# EAGLE board Resistor_Resistor (EAGLE 8.3.0), part 11 of 32
## Placement (x,y rotation side) (continued)
R13010  10K  [0201]  104.6,6.76 0 top
R13011  10K  [0201]  104.6,7.37 0 top
R13012  10K  [0201]  104.6,7.98 0 top
R13013  10K  [0201]  104.6,8.59 0 top
R13014  10K  [0201]  104.6,9.19 0 top
R13015  10K  [0201]  104.6,9.8 0 top
R13016  10K  [0201]  104.6,10.41 0 top
R13017  10K  [0201]  104.6,11.02 0 top
R13018  10K  [0201]  104.6,11.63 0 top
R13019  10K  [0201]  104.6,12.24 0 top
R13020  10K  [0201]  104.6,12.85 0 top
R13021  10K  [0201]  104.6,13.46 0 top
R13022  10K  [0201]  104.6,14.07 0 top
R13023  10K  [0201]  104.6,14.68 0 top
R13024  10K  [0201]  104.6,15.29 0 top
R13025  10K  [0201]  104.6,15.9 0 top
R13026  10K  [0201]  104.6,16.51 0 top
R13027  10K  [0201]  104.6,17.12 0 top
R13028  10K  [0201]  104.6,17.73 0 top
R13029  10K  [0201]  104.6,18.34 0 top
R13030  10K  [0201]  104.6,18.95 0 top
R13031  10K  [0201]  104.6,19.56 0 top
R13032  10K  [0201]  104.6,20.17 0 top
R13033  10K  [0201]  104.6,20.78 0 top
R13034  10K  [0201]  104.6,21.39 0 top
R13035  10K  [0201]  104.6,22 0 top
R13036  10K  [0201]  104.6,22.61 0 top
R13037  10K  [0201]  104.6,23.22 0 top
R13038  10K  [0201]  104.6,23.83 0 top
R13039  10K  [0201]  104.6,24.43 0 top
R13040  10K  [0201]  104.6,25.04 0 top
R13041  10K  [0201]  104.6,25.65 0 top
R13042  10K  [0201]  104.6,26.26 0 top
R13043  10K  [0201]  104.6,26.87 0 top
R13044  10K  [0201]  104.6,27.48 0 top
R13045  10K  [0201]  104.6,28.09 0 top
R13046  10K  [0201]  104.6,28.7 0 top
R13047  10K  [0201]  104.6,29.31 0 top
R13048  10K  [0201]  104.6,29.92 0 top
R13049  10K  [0201]  104.6,30.53 0 top
R13050  10K  [0201]  104.6,31.14 0 top
R13051  10K  [0201]  104.6,31.75 0 top
R13052  10K  [0201]  104.6,32.36 0 top
R13053  10K  [0201]  104.6,32.97 0 top
R13054  10K  [0201]  104.6,33.58 0 top
R13055  10K  [0201]  104.6,34.19 0 top
R13056  10K  [0201]  104.6,34.8 0 top
R13057  10K  [0201]  104.6,35.41 0 top
R13058  10K  [0201]  104.6,36.02 0 top
R13059  10K  [0201]  104.6,36.63 0 top
R13060  10K  [0201]  104.6,37.24 0 top
R13061  10K  [0201]  104.6,37.85 0 top
R13062  10K  [0201]  104.6,38.46 0 top
R13063  10K  [0201]  104.6,39.07 0 top
R13064  10K  [0201]  104.6,39.67 0 top
R13065  10K  [0201]  104.6,40.28 0 top
R13066  10K  [0201]  104.6,40.89 0 top
R13067  10K  [0201]  104.6,41.5 0 top
R13068  10K  [0201]  104.6,42.11 0 top
R13069  10K  [0201]  104.6,42.72 0 top
R13070  10K  [0201]  104.6,43.33 0 top
R13071  10K  [0201]  104.6,43.94 0 top
R13072  10K  [0201]  104.6,44.55 0 top
R13073  10K  [0201]  104.6,45.16 0 top
R13074  10K  [0201]  104.6,45.77 0 top
R13075  10K  [0201]  104.6,46.38 0 top
R13076  10K  [0201]  104.6,46.99 0 top
R13077  10K  [0201]  104.6,47.6 0 top
R13078  10K  [0201]  104.6,48.21 0 top
R13079  10K  [0201]  104.6,48.82 0 top
R13080  10K  [0201]  104.6,49.43 0 top
R13081  10K  [0201]  104.6,50.04 0 top
R13082  10K  [0201]  104.6,50.65 0 top
R13083  10K  [0201]  104.6,51.26 0 top
R13084  10K  [0201]  104.6,51.87 0 top
R13085  10K  [0201]  104.6,52.48 0 top
R13086  10K  [0201]  104.6,53.09 0 top
R13087  10K  [0201]  104.6,53.7 0 top
R13088  10K  [0201]  104.6,54.31 0 top
R13089  10K  [0201]  104.6,54.91 0 top
R13090  10K  [0201]  104.6,55.52 0 top
R13091  10K  [0201]  104.6,56.13 0 top
R13092  10K  [0201]  104.6,56.74 0 top
R13093  10K  [0201]  104.6,57.35 0 top
R13094  10K  [0201]  104.6,57.96 0 top
R13095  10K  [0201]  104.6,58.57 0 top
R13096  10K  [0201]  104.6,59.18 0 top
R13097  10K  [0201]  104.6,59.79 0 top
R13098  10K  [0201]  104.6,60.4 0 top
R13099  10K  [0201]  104.6,61.01 0 top
R13100  10K  [0201]  104.6,61.62 0 top
R13101  10K  [0201]  104.6,62.23 0 top
R13102  10K  [0201]  104.6,62.84 0 top
R13103  10K  [0201]  104.6,63.45 0 top
R13104  10K  [0201]  104.6,64.06 0 top
R13105  10K  [0201]  104.6,64.67 0 top
R13106  10K  [0201]  104.6,65.28 0 top
R13107  10K  [0201]  104.6,65.89 0 top
R13108  10K  [0201]  104.6,66.5 0 top
R13109  10K  [0201]  104.6,67.11 0 top
R13110  10K  [0201]  104.6,67.72 0 top
R13111  10K  [0201]  104.6,68.33 0 top
R13112  10K  [0201]  104.6,68.94 0 top
R13113  10K  [0201]  104.6,69.55 0 top
R13114  10K  [0201]  104.6,70.15 0 top
R13115  10K  [0201]  104.6,70.76 0 top
R13116  10K  [0201]  104.6,71.37 0 top
R13117  10K  [0201]  104.6,71.98 0 top
R13118  10K  [0201]  104.6,72.59 0 top
R13119  10K  [0201]  104.6,73.2 0 top
R13120  10K  [0201]  104.6,73.81 0 top
R13121  10K  [0201]  104.6,74.42 0 top
R13122  10K  [0201]  104.6,75.03 0 top
R13123  10K  [0201]  104.6,75.64 0 top
R13124  10K  [0201]  104.6,76.25 0 top
R13125  10K  [0201]  104.6,76.86 0 top
R13126  10K  [0201]  104.6,77.47 0 top
R13127  10K  [0201]  104.6,78.08 0 top
R13128  10K  [0201]  104.6,78.69 0 top
R13129  10K  [0201]  104.6,79.3 0 top
R13130  10K  [0201]  104.6,79.91 0 top
R13131  10K  [0201]  104.6,80.52 0 top
R13132  10K  [0201]  104.6,81.13 0 top
R13133  10K  [0201]  104.6,81.74 0 top
R13134  10K  [0201]  104.6,82.35 0 top
R13135  10K  [0201]  104.6,82.96 0 top
R13136  10K  [0201]  104.6,83.57 0 top
R13137  10K  [0201]  104.6,84.18 0 top
R13138  10K  [0201]  104.6,84.79 0 top
R13139  10K  [0201]  104.6,85.39 0 top
R13140  10K  [0201]  104.6,86 0 top
R13141  10K  [0201]  104.6,86.61 0 top
R13142  10K  [0201]  104.6,87.22 0 top
R13143  10K  [0201]  104.6,87.83 0 top
R13144  10K  [0201]  104.6,88.44 0 top
R13145  10K  [0201]  104.6,89.05 0 top
R13146  10K  [0201]  104.6,89.66 0 top
R13147  10K  [0201]  104.6,90.27 0 top
R13148  10K  [0201]  104.6,90.88 0 top
R13149  10K  [0201]  104.6,91.49 0 top
R13150  10K  [0201]  104.6,92.1 0 top
R13151  10K  [0201]  104.6,92.71 0 top
R13152  10K  [0201]  104.6,93.32 0 top
R13153  10K  [0201]  104.6,93.93 0 top
R13154  10K  [0201]  104.6,94.54 0 top
R13155  10K  [0201]  104.6,95.15 0 top
R13156  10K  [0201]  104.6,95.76 0 top
R13157  10K  [0201]  104.6,96.37 0 top
R13158  10K  [0201]  104.6,96.98 0 top
R13159  10K  [0201]  104.6,97.59 0 top
R13160  10K  [0201]  104.6,98.2 0 top
R13161  10K  [0201]  104.6,98.81 0 top
R13162  10K  [0201]  104.6,99.42 0 top
R13163  10K  [0201]  104.6,100.03 0 top
R13164  10K  [0201]  104.6,100.63 0 top
R13165  10K  [0201]  104.6,101.24 0 top
R13166  10K  [0201]  104.6,101.85 0 top
R13167  10K  [0201]  104.6,102.46 0 top
R13168  10K  [0201]  104.6,103.07 0 top
R13169  10K  [0201]  104.6,103.68 0 top
R13170  10K  [0201]  104.6,104.29 0 top
R13171  10K  [0201]  104.6,104.9 0 top
R13172  10K  [0201]  104.6,105.51 0 top
R13173  10K  [0201]  104.6,106.12 0 top
R13174  10K  [0201]  104.6,106.73 0 top
R13175  10K  [0201]  104.6,107.34 0 top
R13176  10K  [0201]  104.6,107.95 0 top
R13177  10K  [0201]  104.6,108.56 0 top
R13178  10K  [0201]  104.6,109.17 0 top
R13179  10K  [0201]  104.6,109.78 0 top
R13180  10K  [0201]  104.6,110.39 0 top
R13181  10K  [0201]  104.6,111 0 top
R13182  10K  [0201]  104.6,111.61 0 top
R13183  10K  [0201]  104.6,112.22 0 top
R13184  10K  [0201]  104.6,112.83 0 top
R13185  10K  [0201]  104.6,113.44 0 top
R13186  10K  [0201]  104.6,114.05 0 top
R13187  10K  [0201]  104.6,114.66 0 top
R13188  10K  [0201]  104.6,115.27 0 top
R13189  10K  [0201]  104.6,115.87 0 top
R13190  10K  [0201]  104.6,116.48 0 top
R13191  10K  [0201]  104.6,117.09 0 top
R13192  10K  [0201]  104.6,117.7 0 top
R13193  10K  [0201]  104.6,118.31 0 top
R13194  10K  [0201]  104.6,118.92 0 top
R13195  10K  [0201]  104.6,119.53 0 top
R13196  10K  [0201]  104.6,120.14 0 top
R13197  10K  [0201]  104.6,120.75 0 top
R13198  10K  [0201]  104.6,121.36 0 top
R13199  10K  [0201]  104.6,121.97 0 top
R13200  10K  [0201]  104.6,122.58 0 top
R13201  10K  [0201]  105.82,1.27 0 top
R13202  10K  [0201]  105.82,1.88 0 top
R13203  10K  [0201]  105.82,2.49 0 top
R13204  10K  [0201]  105.82,3.1 0 top
R13205  10K  [0201]  105.82,3.71 0 top
R13206  10K  [0201]  105.82,4.32 0 top
R13207  10K  [0201]  105.82,4.93 0 top
R13208  10K  [0201]  105.82,5.54 0 top
R13209  10K  [0201]  105.82,6.15 0 top
R13210  10K  [0201]  105.82,6.76 0 top
R13211  10K  [0201]  105.82,7.37 0 top
R13212  10K  [0201]  105.82,7.98 0 top
R13213  10K  [0201]  105.82,8.59 0 top
R13214  10K  [0201]  105.82,9.19 0 top
R13215  10K  [0201]  105.82,9.8 0 top
R13216  10K  [0201]  105.82,10.41 0 top
R13217  10K  [0201]  105.82,11.02 0 top
R13218  10K  [0201]  105.82,11.63 0 top
R13219  10K  [0201]  105.82,12.24 0 top
R13220  10K  [0201]  105.82,12.85 0 top
R13221  10K  [0201]  105.82,13.46 0 top
R13222  10K  [0201]  105.82,14.07 0 top
R13223  10K  [0201]  105.82,14.68 0 top
R13224  10K  [0201]  105.82,15.29 0 top
R13225  10K  [0201]  105.82,15.9 0 top
R13226  10K  [0201]  105.82,16.51 0 top
R13227  10K  [0201]  105.82,17.12 0 top
R13228  10K  [0201]  105.82,17.73 0 top
R13229  10K  [0201]  105.82,18.34 0 top
R13230  10K  [0201]  105.82,18.95 0 top
R13231  10K  [0201]  105.82,19.56 0 top
R13232  10K  [0201]  105.82,20.17 0 top
R13233  10K  [0201]  105.82,20.78 0 top
R13234  10K  [0201]  105.82,21.39 0 top
R13235  10K  [0201]  105.82,22 0 top
R13236  10K  [0201]  105.82,22.61 0 top
R13237  10K  [0201]  105.82,23.22 0 top
R13238  10K  [0201]  105.82,23.83 0 top
R13239  10K  [0201]  105.82,24.43 0 top
R13240  10K  [0201]  105.82,25.04 0 top
R13241  10K  [0201]  105.82,25.65 0 top
R13242  10K  [0201]  105.82,26.26 0 top
R13243  10K  [0201]  105.82,26.87 0 top
R13244  10K  [0201]  105.82,27.48 0 top
R13245  10K  [0201]  105.82,28.09 0 top
R13246  10K  [0201]  105.82,28.7 0 top
R13247  10K  [0201]  105.82,29.31 0 top
R13248  10K  [0201]  105.82,29.92 0 top
R13249  10K  [0201]  105.82,30.53 0 top
R13250  10K  [0201]  105.82,31.14 0 top
R13251  10K  [0201]  105.82,31.75 0 top
R13252  10K  [0201]  105.82,32.36 0 top
R13253  10K  [0201]  105.82,32.97 0 top
R13254  10K  [0201]  105.82,33.58 0 top
R13255  10K  [0201]  105.82,34.19 0 top
R13256  10K  [0201]  105.82,34.8 0 top
R13257  10K  [0201]  105.82,35.41 0 top
R13258  10K  [0201]  105.82,36.02 0 top
R13259  10K  [0201]  105.82,36.63 0 top
R13260  10K  [0201]  105.82,37.24 0 top
R13261  10K  [0201]  105.82,37.85 0 top
R13262  10K  [0201]  105.82,38.46 0 top
R13263  10K  [0201]  105.82,39.07 0 top
R13264  10K  [0201]  105.82,39.67 0 top
R13265  10K  [0201]  105.82,40.28 0 top
R13266  10K  [0201]  105.82,40.89 0 top
R13267  10K  [0201]  105.82,41.5 0 top
R13268  10K  [0201]  105.82,42.11 0 top
R13269  10K  [0201]  105.82,42.72 0 top
R13270  10K  [0201]  105.82,43.33 0 top
R13271  10K  [0201]  105.82,43.94 0 top
R13272  10K  [0201]  105.82,44.55 0 top
R13273  10K  [0201]  105.82,45.16 0 top
R13274  10K  [0201]  105.82,45.77 0 top
R13275  10K  [0201]  105.82,46.38 0 top
R13276  10K  [0201]  105.82,46.99 0 top
R13277  10K  [0201]  105.82,47.6 0 top
R13278  10K  [0201]  105.82,48.21 0 top
R13279  10K  [0201]  105.82,48.82 0 top
R13280  10K  [0201]  105.82,49.43 0 top
R13281  10K  [0201]  105.82,50.04 0 top
R13282  10K  [0201]  105.82,50.65 0 top
R13283  10K  [0201]  105.82,51.26 0 top
R13284  10K  [0201]  105.82,51.87 0 top
R13285  10K  [0201]  105.82,52.48 0 top
R13286  10K  [0201]  105.82,53.09 0 top
R13287  10K  [0201]  105.82,53.7 0 top
R13288  10K  [0201]  105.82,54.31 0 top
R13289  10K  [0201]  105.82,54.91 0 top
R13290  10K  [0201]  105.82,55.52 0 top
R13291  10K  [0201]  105.82,56.13 0 top
R13292  10K  [0201]  105.82,56.74 0 top
R13293  10K  [0201]  105.82,57.35 0 top
R13294  10K  [0201]  105.82,57.96 0 top
R13295  10K  [0201]  105.82,58.57 0 top
R13296  10K  [0201]  105.82,59.18 0 top
R13297  10K  [0201]  105.82,59.79 0 top
R13298  10K  [0201]  105.82,60.4 0 top
R13299  10K  [0201]  105.82,61.01 0 top
R13300  10K  [0201]  105.82,61.62 0 top
R13301  10K  [0201]  105.82,62.23 0 top
R13302  10K  [0201]  105.82,62.84 0 top
R13303  10K  [0201]  105.82,63.45 0 top
R13304  10K  [0201]  105.82,64.06 0 top
R13305  10K  [0201]  105.82,64.67 0 top
R13306  10K  [0201]  105.82,65.28 0 top
R13307  10K  [0201]  105.82,65.89 0 top
R13308  10K  [0201]  105.82,66.5 0 top
R13309  10K  [0201]  105.82,67.11 0 top
R13310  10K  [0201]  105.82,67.72 0 top
R13311  10K  [0201]  105.82,68.33 0 top
R13312  10K  [0201]  105.82,68.94 0 top
R13313  10K  [0201]  105.82,69.55 0 top
R13314  10K  [0201]  105.82,70.15 0 top
R13315  10K  [0201]  105.82,70.76 0 top
R13316  10K  [0201]  105.82,71.37 0 top
R13317  10K  [0201]  105.82,71.98 0 top
R13318  10K  [0201]  105.82,72.59 0 top
R13319  10K  [0201]  105.82,73.2 0 top
R13320  10K  [0201]  105.82,73.81 0 top
R13321  10K  [0201]  105.82,74.42 0 top
R13322  10K  [0201]  105.82,75.03 0 top
R13323  10K  [0201]  105.82,75.64 0 top
R13324  10K  [0201]  105.82,76.25 0 top
R13325  10K  [0201]  105.82,76.86 0 top
R13326  10K  [0201]  105.82,77.47 0 top
R13327  10K  [0201]  105.82,78.08 0 top
R13328  10K  [0201]  105.82,78.69 0 top
R13329  10K  [0201]  105.82,79.3 0 top
R13330  10K  [0201]  105.82,79.91 0 top
R13331  10K  [0201]  105.82,80.52 0 top
R13332  10K  [0201]  105.82,81.13 0 top
R13333  10K  [0201]  105.82,81.74 0 top
R13334  10K  [0201]  105.82,82.35 0 top
R13335  10K  [0201]  105.82,82.96 0 top
R13336  10K  [0201]  105.82,83.57 0 top
R13337  10K  [0201]  105.82,84.18 0 top
R13338  10K  [0201]  105.82,84.79 0 top
R13339  10K  [0201]  105.82,85.39 0 top
R13340  10K  [0201]  105.82,86 0 top
R13341  10K  [0201]  105.82,86.61 0 top
R13342  10K  [0201]  105.82,87.22 0 top
R13343  10K  [0201]  105.82,87.83 0 top
R13344  10K  [0201]  105.82,88.44 0 top
R13345  10K  [0201]  105.82,89.05 0 top
R13346  10K  [0201]  105.82,89.66 0 top
R13347  10K  [0201]  105.82,90.27 0 top
R13348  10K  [0201]  105.82,90.88 0 top
R13349  10K  [0201]  105.82,91.49 0 top
R13350  10K  [0201]  105.82,92.1 0 top
R13351  10K  [0201]  105.82,92.71 0 top
R13352  10K  [0201]  105.82,93.32 0 top
R13353  10K  [0201]  105.82,93.93 0 top
R13354  10K  [0201]  105.82,94.54 0 top
R13355  10K  [0201]  105.82,95.15 0 top
R13356  10K  [0201]  105.82,95.76 0 top
R13357  10K  [0201]  105.82,96.37 0 top
R13358  10K  [0201]  105.82,96.98 0 top
R13359  10K  [0201]  105.82,97.59 0 top
R13360  10K  [0201]  105.82,98.2 0 top
R13361  10K  [0201]  105.82,98.81 0 top
R13362  10K  [0201]  105.82,99.42 0 top
R13363  10K  [0201]  105.82,100.03 0 top
R13364  10K  [0201]  105.82,100.63 0 top
R13365  10K  [0201]  105.82,101.24 0 top
R13366  10K  [0201]  105.82,101.85 0 top
R13367  10K  [0201]  105.82,102.46 0 top
R13368  10K  [0201]  105.82,103.07 0 top
R13369  10K  [0201]  105.82,103.68 0 top
R13370  10K  [0201]  105.82,104.29 0 top
R13371  10K  [0201]  105.82,104.9 0 top
R13372  10K  [0201]  105.82,105.51 0 top
R13373  10K  [0201]  105.82,106.12 0 top
R13374  10K  [0201]  105.82,106.73 0 top
R13375  10K  [0201]  105.82,107.34 0 top
R13376  10K  [0201]  105.82,107.95 0 top
R13377  10K  [0201]  105.82,108.56 0 top
R13378  10K  [0201]  105.82,109.17 0 top
R13379  10K  [0201]  105.82,109.78 0 top
R13380  10K  [0201]  105.82,110.39 0 top
R13381  10K  [0201]  105.82,111 0 top
R13382  10K  [0201]  105.82,111.61 0 top
R13383  10K  [0201]  105.82,112.22 0 top
R13384  10K  [0201]  105.82,112.83 0 top
R13385  10K  [0201]  105.82,113.44 0 top
R13386  10K  [0201]  105.82,114.05 0 top
R13387  10K  [0201]  105.82,114.66 0 top
R13388  10K  [0201]  105.82,115.27 0 top
R13389  10K  [0201]  105.82,115.87 0 top
R13390  10K  [0201]  105.82,116.48 0 top
R13391  10K  [0201]  105.82,117.09 0 top
R13392  10K  [0201]  105.82,117.7 0 top
R13393  10K  [0201]  105.82,118.31 0 top
R13394  10K  [0201]  105.82,118.92 0 top
R13395  10K  [0201]  105.82,119.53 0 top
R13396  10K  [0201]  105.82,120.14 0 top
R13397  10K  [0201]  105.82,120.75 0 top
R13398  10K  [0201]  105.82,121.36 0 top
R13399  10K  [0201]  105.82,121.97 0 top
R13400  10K  [0201]  105.82,122.58 0 top
R13401  10K  [0201]  107.04,1.27 0 top
R13402  10K  [0201]  107.04,1.88 0 top
R13403  10K  [0201]  107.04,2.49 0 top
R13404  10K  [0201]  107.04,3.1 0 top
R13405  10K  [0201]  107.04,3.71 0 top
R13406  10K  [0201]  107.04,4.32 0 top
R13407  10K  [0201]  107.04,4.93 0 top
R13408  10K  [0201]  107.04,5.54 0 top
R13409  10K  [0201]  107.04,6.15 0 top
R13410  10K  [0201]  107.04,6.76 0 top
R13411  10K  [0201]  107.04,7.37 0 top
R13412  10K  [0201]  107.04,7.98 0 top
R13413  10K  [0201]  107.04,8.59 0 top
R13414  10K  [0201]  107.04,9.19 0 top
R13415  10K  [0201]  107.04,9.8 0 top
R13416  10K  [0201]  107.04,10.41 0 top
R13417  10K  [0201]  107.04,11.02 0 top
R13418  10K  [0201]  107.04,11.63 0 top
R13419  10K  [0201]  107.04,12.24 0 top
R13420  10K  [0201]  107.04,12.85 0 top
R13421  10K  [0201]  107.04,13.46 0 top
R13422  10K  [0201]  107.04,14.07 0 top
R13423  10K  [0201]  107.04,14.68 0 top
R13424  10K  [0201]  107.04,15.29 0 top
R13425  10K  [0201]  107.04,15.9 0 top
R13426  10K  [0201]  107.04,16.51 0 top
R13427  10K  [0201]  107.04,17.12 0 top
R13428  10K  [0201]  107.04,17.73 0 top
R13429  10K  [0201]  107.04,18.34 0 top
R13430  10K  [0201]  107.04,18.95 0 top
R13431  10K  [0201]  107.04,19.56 0 top
R13432  10K  [0201]  107.04,20.17 0 top
R13433  10K  [0201]  107.04,20.78 0 top
R13434  10K  [0201]  107.04,21.39 0 top
R13435  10K  [0201]  107.04,22 0 top
R13436  10K  [0201]  107.04,22.61 0 top
R13437  10K  [0201]  107.04,23.22 0 top
R13438  10K  [0201]  107.04,23.83 0 top
R13439  10K  [0201]  107.04,24.43 0 top
R13440  10K  [0201]  107.04,25.04 0 top
R13441  10K  [0201]  107.04,25.65 0 top
R13442  10K  [0201]  107.04,26.26 0 top
R13443  10K  [0201]  107.04,26.87 0 top
R13444  10K  [0201]  107.04,27.48 0 top
R13445  10K  [0201]  107.04,28.09 0 top
R13446  10K  [0201]  107.04,28.7 0 top
R13447  10K  [0201]  107.04,29.31 0 top
R13448  10K  [0201]  107.04,29.92 0 top
R13449  10K  [0201]  107.04,30.53 0 top
R13450  10K  [0201]  107.04,31.14 0 top
R13451  10K  [0201]  107.04,31.75 0 top
R13452  10K  [0201]  107.04,32.36 0 top
R13453  10K  [0201]  107.04,32.97 0 top
R13454  10K  [0201]  107.04,33.58 0 top
R13455  10K  [0201]  107.04,34.19 0 top
R13456  10K  [0201]  107.04,34.8 0 top
R13457  10K  [0201]  107.04,35.41 0 top
R13458  10K  [0201]  107.04,36.02 0 top
R13459  10K  [0201]  107.04,36.63 0 top
R13460  10K  [0201]  107.04,37.24 0 top
R13461  10K  [0201]  107.04,37.85 0 top
R13462  10K  [0201]  107.04,38.46 0 top
R13463  10K  [0201]  107.04,39.07 0 top
R13464  10K  [0201]  107.04,39.67 0 top
R13465  10K  [0201]  107.04,40.28 0 top
R13466  10K  [0201]  107.04,40.89 0 top
R13467  10K  [0201]  107.04,41.5 0 top
R13468  10K  [0201]  107.04,42.11 0 top
R13469  10K  [0201]  107.04,42.72 0 top
R13470  10K  [0201]  107.04,43.33 0 top
R13471  10K  [0201]  107.04,43.94 0 top
R13472  10K  [0201]  107.04,44.55 0 top
R13473  10K  [0201]  107.04,45.16 0 top
R13474  10K  [0201]  107.04,45.77 0 top
R13475  10K  [0201]  107.04,46.38 0 top
R13476  10K  [0201]  107.04,46.99 0 top
R13477  10K  [0201]  107.04,47.6 0 top
R13478  10K  [0201]  107.04,48.21 0 top
R13479  10K  [0201]  107.04,48.82 0 top
R13480  10K  [0201]  107.04,49.43 0 top
R13481  10K  [0201]  107.04,50.04 0 top
R13482  10K  [0201]  107.04,50.65 0 top
R13483  10K  [0201]  107.04,51.26 0 top
R13484  10K  [0201]  107.04,51.87 0 top
R13485  10K  [0201]  107.04,52.48 0 top
R13486  10K  [0201]  107.04,53.09 0 top
R13487  10K  [0201]  107.04,53.7 0 top
R13488  10K  [0201]  107.04,54.31 0 top
R13489  10K  [0201]  107.04,54.91 0 top
R13490  10K  [0201]  107.04,55.52 0 top
R13491  10K  [0201]  107.04,56.13 0 top
R13492  10K  [0201]  107.04,56.74 0 top
R13493  10K  [0201]  107.04,57.35 0 top
R13494  10K  [0201]  107.04,57.96 0 top
R13495  10K  [0201]  107.04,58.57 0 top
R13496  10K  [0201]  107.04,59.18 0 top
R13497  10K  [0201]  107.04,59.79 0 top
R13498  10K  [0201]  107.04,60.4 0 top
R13499  10K  [0201]  107.04,61.01 0 top
R13500  10K  [0201]  107.04,61.62 0 top
R13501  10K  [0201]  107.04,62.23 0 top
R13502  10K  [0201]  107.04,62.84 0 top
R13503  10K  [0201]  107.04,63.45 0 top
R13504  10K  [0201]  107.04,64.06 0 top
R13505  10K  [0201]  107.04,64.67 0 top
R13506  10K  [0201]  107.04,65.28 0 top
R13507  10K  [0201]  107.04,65.89 0 top
R13508  10K  [0201]  107.04,66.5 0 top
R13509  10K  [0201]  107.04,67.11 0 top
R13510  10K  [0201]  107.04,67.72 0 top
R13511  10K  [0201]  107.04,68.33 0 top
R13512  10K  [0201]  107.04,68.94 0 top
R13513  10K  [0201]  107.04,69.55 0 top
R13514  10K  [0201]  107.04,70.15 0 top
R13515  10K  [0201]  107.04,70.76 0 top
R13516  10K  [0201]  107.04,71.37 0 top
R13517  10K  [0201]  107.04,71.98 0 top
R13518  10K  [0201]  107.04,72.59 0 top
R13519  10K  [0201]  107.04,73.2 0 top
R13520  10K  [0201]  107.04,73.81 0 top
R13521  10K  [0201]  107.04,74.42 0 top
R13522  10K  [0201]  107.04,75.03 0 top
R13523  10K  [0201]  107.04,75.64 0 top
R13524  10K  [0201]  107.04,76.25 0 top
R13525  10K  [0201]  107.04,76.86 0 top
R13526  10K  [0201]  107.04,77.47 0 top
R13527  10K  [0201]  107.04,78.08 0 top
R13528  10K  [0201]  107.04,78.69 0 top
R13529  10K  [0201]  107.04,79.3 0 top
R13530  10K  [0201]  107.04,79.91 0 top
R13531  10K  [0201]  107.04,80.52 0 top
R13532  10K  [0201]  107.04,81.13 0 top
R13533  10K  [0201]  107.04,81.74 0 top
R13534  10K  [0201]  107.04,82.35 0 top
R13535  10K  [0201]  107.04,82.96 0 top
R13536  10K  [0201]  107.04,83.57 0 top
R13537  10K  [0201]  107.04,84.18 0 top
R13538  10K  [0201]  107.04,84.79 0 top
R13539  10K  [0201]  107.04,85.39 0 top
R13540  10K  [0201]  107.04,86 0 top
R13541  10K  [0201]  107.04,86.61 0 top
R13542  10K  [0201]  107.04,87.22 0 top
R13543  10K  [0201]  107.04,87.83 0 top
R13544  10K  [0201]  107.04,88.44 0 top
R13545  10K  [0201]  107.04,89.05 0 top
R13546  10K  [0201]  107.04,89.66 0 top
R13547  10K  [0201]  107.04,90.27 0 top
R13548  10K  [0201]  107.04,90.88 0 top
R13549  10K  [0201]  107.04,91.49 0 top
R13550  10K  [0201]  107.04,92.1 0 top
R13551  10K  [0201]  107.04,92.71 0 top
R13552  10K  [0201]  107.04,93.32 0 top
R13553  10K  [0201]  107.04,93.93 0 top
R13554  10K  [0201]  107.04,94.54 0 top
R13555  10K  [0201]  107.04,95.15 0 top
R13556  10K  [0201]  107.04,95.76 0 top
R13557  10K  [0201]  107.04,96.37 0 top
R13558  10K  [0201]  107.04,96.98 0 top
R13559  10K  [0201]  107.04,97.59 0 top
R13560  10K  [0201]  107.04,98.2 0 top
R13561  10K  [0201]  107.04,98.81 0 top
R13562  10K  [0201]  107.04,99.42 0 top
R13563  10K  [0201]  107.04,100.03 0 top
R13564  10K  [0201]  107.04,100.63 0 top
R13565  10K  [0201]  107.04,101.24 0 top
R13566  10K  [0201]  107.04,101.85 0 top
R13567  10K  [0201]  107.04,102.46 0 top
R13568  10K  [0201]  107.04,103.07 0 top
R13569  10K  [0201]  107.04,103.68 0 top
R13570  10K  [0201]  107.04,104.29 0 top
R13571  10K  [0201]  107.04,104.9 0 top
R13572  10K  [0201]  107.04,105.51 0 top
R13573  10K  [0201]  107.04,106.12 0 top
R13574  10K  [0201]  107.04,106.73 0 top
R13575  10K  [0201]  107.04,107.34 0 top
R13576  10K  [0201]  107.04,107.95 0 top
R13577  10K  [0201]  107.04,108.56 0 top
R13578  10K  [0201]  107.04,109.17 0 top
R13579  10K  [0201]  107.04,109.78 0 top
R13580  10K  [0201]  107.04,110.39 0 top
R13581  10K  [0201]  107.04,111 0 top
R13582  10K  [0201]  107.04,111.61 0 top
R13583  10K  [0201]  107.04,112.22 0 top
R13584  10K  [0201]  107.04,112.83 0 top
R13585  10K  [0201]  107.04,113.44 0 top
R13586  10K  [0201]  107.04,114.05 0 top
R13587  10K  [0201]  107.04,114.66 0 top
R13588  10K  [0201]  107.04,115.27 0 top
R13589  10K  [0201]  107.04,115.87 0 top
R13590  10K  [0201]  107.04,116.48 0 top
R13591  10K  [0201]  107.04,117.09 0 top
R13592  10K  [0201]  107.04,117.7 0 top
R13593  10K  [0201]  107.04,118.31 0 top
R13594  10K  [0201]  107.04,118.92 0 top
R13595  10K  [0201]  107.04,119.53 0 top
R13596  10K  [0201]  107.04,120.14 0 top
R13597  10K  [0201]  107.04,120.75 0 top
R13598  10K  [0201]  107.04,121.36 0 top
R13599  10K  [0201]  107.04,121.97 0 top
R13600  10K  [0201]  107.04,122.58 0 top
R13601  10K  [0201]  108.25,1.27 0 top
R13602  10K  [0201]  108.25,1.88 0 top
R13603  10K  [0201]  108.25,2.49 0 top
R13604  10K  [0201]  108.25,3.1 0 top
R13605  10K  [0201]  108.25,3.71 0 top
R13606  10K  [0201]  108.25,4.32 0 top
R13607  10K  [0201]  108.25,4.93 0 top
R13608  10K  [0201]  108.25,5.54 0 top
R13609  10K  [0201]  108.25,6.15 0 top
R13610  10K  [0201]  108.25,6.76 0 top
R13611  10K  [0201]  108.25,7.37 0 top
R13612  10K  [0201]  108.25,7.98 0 top
R13613  10K  [0201]  108.25,8.59 0 top
R13614  10K  [0201]  108.25,9.19 0 top
R13615  10K  [0201]  108.25,9.8 0 top
R13616  10K  [0201]  108.25,10.41 0 top
R13617  10K  [0201]  108.25,11.02 0 top
R13618  10K  [0201]  108.25,11.63 0 top
R13619  10K  [0201]  108.25,12.24 0 top
R13620  10K  [0201]  108.25,12.85 0 top
R13621  10K  [0201]  108.25,13.46 0 top
R13622  10K  [0201]  108.25,14.07 0 top
R13623  10K  [0201]  108.25,14.68 0 top
R13624  10K  [0201]  108.25,15.29 0 top
R13625  10K  [0201]  108.25,15.9 0 top
R13626  10K  [0201]  108.25,16.51 0 top
R13627  10K  [0201]  108.25,17.12 0 top
R13628  10K  [0201]  108.25,17.73 0 top
R13629  10K  [0201]  108.25,18.34 0 top
R13630  10K  [0201]  108.25,18.95 0 top
R13631  10K  [0201]  108.25,19.56 0 top
R13632  10K  [0201]  108.25,20.17 0 top
R13633  10K  [0201]  108.25,20.78 0 top
R13634  10K  [0201]  108.25,21.39 0 top
R13635  10K  [0201]  108.25,22 0 top
R13636  10K  [0201]  108.25,22.61 0 top
R13637  10K  [0201]  108.25,23.22 0 top
R13638  10K  [0201]  108.25,23.83 0 top
R13639  10K  [0201]  108.25,24.43 0 top
R13640  10K  [0201]  108.25,25.04 0 top
R13641  10K  [0201]  108.25,25.65 0 top
R13642  10K  [0201]  108.25,26.26 0 top
R13643  10K  [0201]  108.25,26.87 0 top
R13644  10K  [0201]  108.25,27.48 0 top
R13645  10K  [0201]  108.25,28.09 0 top
R13646  10K  [0201]  108.25,28.7 0 top
R13647  10K  [0201]  108.25,29.31 0 top
R13648  10K  [0201]  108.25,29.92 0 top
R13649  10K  [0201]  108.25,30.53 0 top
R13650  10K  [0201]  108.25,31.14 0 top
R13651  10K  [0201]  108.25,31.75 0 top
R13652  10K  [0201]  108.25,32.36 0 top
R13653  10K  [0201]  108.25,32.97 0 top
R13654  10K  [0201]  108.25,33.58 0 top
R13655  10K  [0201]  108.25,34.19 0 top
R13656  10K  [0201]  108.25,34.8 0 top
R13657  10K  [0201]  108.25,35.41 0 top
R13658  10K  [0201]  108.25,36.02 0 top
R13659  10K  [0201]  108.25,36.63 0 top
R13660  10K  [0201]  108.25,37.24 0 top
R13661  10K  [0201]  108.25,37.85 0 top
R13662  10K  [0201]  108.25,38.46 0 top
R13663  10K  [0201]  108.25,39.07 0 top
R13664  10K  [0201]  108.25,39.67 0 top
R13665  10K  [0201]  108.25,40.28 0 top
R13666  10K  [0201]  108.25,40.89 0 top
R13667  10K  [0201]  108.25,41.5 0 top
R13668  10K  [0201]  108.25,42.11 0 top
R13669  10K  [0201]  108.25,42.72 0 top
R13670  10K  [0201]  108.25,43.33 0 top
R13671  10K  [0201]  108.25,43.94 0 top
R13672  10K  [0201]  108.25,44.55 0 top
R13673  10K  [0201]  108.25,45.16 0 top
R13674  10K  [0201]  108.25,45.77 0 top
R13675  10K  [0201]  108.25,46.38 0 top
R13676  10K  [0201]  108.25,46.99 0 top
R13677  10K  [0201]  108.25,47.6 0 top
R13678  10K  [0201]  108.25,48.21 0 top
R13679  10K  [0201]  108.25,48.82 0 top
R13680  10K  [0201]  108.25,49.43 0 top
R13681  10K  [0201]  108.25,50.04 0 top
R13682  10K  [0201]  108.25,50.65 0 top
R13683  10K  [0201]  108.25,51.26 0 top
R13684  10K  [0201]  108.25,51.87 0 top
R13685  10K  [0201]  108.25,52.48 0 top
R13686  10K  [0201]  108.25,53.09 0 top
R13687  10K  [0201]  108.25,53.7 0 top
R13688  10K  [0201]  108.25,54.31 0 top
R13689  10K  [0201]  108.25,54.91 0 top
R13690  10K  [0201]  108.25,55.52 0 top
R13691  10K  [0201]  108.25,56.13 0 top
R13692  10K  [0201]  108.25,56.74 0 top
R13693  10K  [0201]  108.25,57.35 0 top
R13694  10K  [0201]  108.25,57.96 0 top
R13695  10K  [0201]  108.25,58.57 0 top
R13696  10K  [0201]  108.25,59.18 0 top
R13697  10K  [0201]  108.25,59.79 0 top
R13698  10K  [0201]  108.25,60.4 0 top
R13699  10K  [0201]  108.25,61.01 0 top
R13700  10K  [0201]  108.25,61.62 0 top
R13701  10K  [0201]  108.25,62.23 0 top
R13702  10K  [0201]  108.25,62.84 0 top
R13703  10K  [0201]  108.25,63.45 0 top
R13704  10K  [0201]  108.25,64.06 0 top
R13705  10K  [0201]  108.25,64.67 0 top
R13706  10K  [0201]  108.25,65.28 0 top
R13707  10K  [0201]  108.25,65.89 0 top
R13708  10K  [0201]  108.25,66.5 0 top
R13709  10K  [0201]  108.25,67.11 0 top
R13710  10K  [0201]  108.25,67.72 0 top
R13711  10K  [0201]  108.25,68.33 0 top
R13712  10K  [0201]  108.25,68.94 0 top
R13713  10K  [0201]  108.25,69.55 0 top
R13714  10K  [0201]  108.25,70.15 0 top
R13715  10K  [0201]  108.25,70.76 0 top
R13716  10K  [0201]  108.25,71.37 0 top
R13717  10K  [0201]  108.25,71.98 0 top
R13718  10K  [0201]  108.25,72.59 0 top
R13719  10K  [0201]  108.25,73.2 0 top
R13720  10K  [0201]  108.25,73.81 0 top
R13721  10K  [0201]  108.25,74.42 0 top
R13722  10K  [0201]  108.25,75.03 0 top
R13723  10K  [0201]  108.25,75.64 0 top
R13724  10K  [0201]  108.25,76.25 0 top
R13725  10K  [0201]  108.25,76.86 0 top
R13726  10K  [0201]  108.25,77.47 0 top
R13727  10K  [0201]  108.25,78.08 0 top
R13728  10K  [0201]  108.25,78.69 0 top
R13729  10K  [0201]  108.25,79.3 0 top
R13730  10K  [0201]  108.25,79.91 0 top
R13731  10K  [0201]  108.25,80.52 0 top
R13732  10K  [0201]  108.25,81.13 0 top
R13733  10K  [0201]  108.25,81.74 0 top
R13734  10K  [0201]  108.25,82.35 0 top
R13735  10K  [0201]  108.25,82.96 0 top
R13736  10K  [0201]  108.25,83.57 0 top
R13737  10K  [0201]  108.25,84.18 0 top
R13738  10K  [0201]  108.25,84.79 0 top
R13739  10K  [0201]  108.25,85.39 0 top
R13740  10K  [0201]  108.25,86 0 top
R13741  10K  [0201]  108.25,86.61 0 top
R13742  10K  [0201]  108.25,87.22 0 top
R13743  10K  [0201]  108.25,87.83 0 top
R13744  10K  [0201]  108.25,88.44 0 top
R13745  10K  [0201]  108.25,89.05 0 top
R13746  10K  [0201]  108.25,89.66 0 top
R13747  10K  [0201]  108.25,90.27 0 top
R13748  10K  [0201]  108.25,90.88 0 top
R13749  10K  [0201]  108.25,91.49 0 top
R13750  10K  [0201]  108.25,92.1 0 top
R13751  10K  [0201]  108.25,92.71 0 top
R13752  10K  [0201]  108.25,93.32 0 top
R13753  10K  [0201]  108.25,93.93 0 top
R13754  10K  [0201]  108.25,94.54 0 top
R13755  10K  [0201]  108.25,95.15 0 top
R13756  10K  [0201]  108.25,95.76 0 top
R13757  10K  [0201]  108.25,96.37 0 top
R13758  10K  [0201]  108.25,96.98 0 top
R13759  10K  [0201]  108.25,97.59 0 top
R13760  10K  [0201]  108.25,98.2 0 top
R13761  10K  [0201]  108.25,98.81 0 top
R13762  10K  [0201]  108.25,99.42 0 top
R13763  10K  [0201]  108.25,100.03 0 top
R13764  10K  [0201]  108.25,100.63 0 top
R13765  10K  [0201]  108.25,101.24 0 top
R13766  10K  [0201]  108.25,101.85 0 top
R13767  10K  [0201]  108.25,102.46 0 top
R13768  10K  [0201]  108.25,103.07 0 top
R13769  10K  [0201]  108.25,103.68 0 top
R13770  10K  [0201]  108.25,104.29 0 top
R13771  10K  [0201]  108.25,104.9 0 top
R13772  10K  [0201]  108.25,105.51 0 top
R13773  10K  [0201]  108.25,106.12 0 top
R13774  10K  [0201]  108.25,106.73 0 top
R13775  10K  [0201]  108.25,107.34 0 top
R13776  10K  [0201]  108.25,107.95 0 top
R13777  10K  [0201]  108.25,108.56 0 top
R13778  10K  [0201]  108.25,109.17 0 top
R13779  10K  [0201]  108.25,109.78 0 top
R13780  10K  [0201]  108.25,110.39 0 top
R13781  10K  [0201]  108.25,111 0 top
R13782  10K  [0201]  108.25,111.61 0 top
R13783  10K  [0201]  108.25,112.22 0 top
R13784  10K  [0201]  108.25,112.83 0 top
R13785  10K  [0201]  108.25,113.44 0 top
R13786  10K  [0201]  108.25,114.05 0 top
R13787  10K  [0201]  108.25,114.66 0 top
R13788  10K  [0201]  108.25,115.27 0 top
R13789  10K  [0201]  108.25,115.87 0 top
R13790  10K  [0201]  108.25,116.48 0 top
R13791  10K  [0201]  108.25,117.09 0 top
R13792  10K  [0201]  108.25,117.7 0 top
R13793  10K  [0201]  108.25,118.31 0 top
R13794  10K  [0201]  108.25,118.92 0 top
R13795  10K  [0201]  108.25,119.53 0 top
R13796  10K  [0201]  108.25,120.14 0 top
R13797  10K  [0201]  108.25,120.75 0 top
R13798  10K  [0201]  108.25,121.36 0 top
R13799  10K  [0201]  108.25,121.97 0 top
R13800  10K  [0201]  108.25,122.58 0 top
R13801  10K  [0201]  109.47,1.27 0 top
R13802  10K  [0201]  109.47,1.88 0 top
R13803  10K  [0201]  109.47,2.49 0 top
R13804  10K  [0201]  109.47,3.1 0 top
R13805  10K  [0201]  109.47,3.71 0 top
R13806  10K  [0201]  109.47,4.32 0 top
R13807  10K  [0201]  109.47,4.93 0 top
R13808  10K  [0201]  109.47,5.54 0 top
R13809  10K  [0201]  109.47,6.15 0 top
R13810  10K  [0201]  109.47,6.76 0 top
R13811  10K  [0201]  109.47,7.37 0 top
R13812  10K  [0201]  109.47,7.98 0 top
R13813  10K  [0201]  109.47,8.59 0 top
R13814  10K  [0201]  109.47,9.19 0 top
R13815  10K  [0201]  109.47,9.8 0 top
R13816  10K  [0201]  109.47,10.41 0 top
R13817  10K  [0201]  109.47,11.02 0 top
R13818  10K  [0201]  109.47,11.63 0 top
R13819  10K  [0201]  109.47,12.24 0 top
R13820  10K  [0201]  109.47,12.85 0 top
R13821  10K  [0201]  109.47,13.46 0 top
R13822  10K  [0201]  109.47,14.07 0 top
R13823  10K  [0201]  109.47,14.68 0 top
R13824  10K  [0201]  109.47,15.29 0 top
R13825  10K  [0201]  109.47,15.9 0 top
R13826  10K  [0201]  109.47,16.51 0 top
R13827  10K  [0201]  109.47,17.12 0 top
R13828  10K  [0201]  109.47,17.73 0 top
R13829  10K  [0201]  109.47,18.34 0 top
R13830  10K  [0201]  109.47,18.95 0 top
R13831  10K  [0201]  109.47,19.56 0 top
R13832  10K  [0201]  109.47,20.17 0 top
R13833  10K  [0201]  109.47,20.78 0 top
R13834  10K  [0201]  109.47,21.39 0 top
R13835  10K  [0201]  109.47,22 0 top
R13836  10K  [0201]  109.47,22.61 0 top
R13837  10K  [0201]  109.47,23.22 0 top
R13838  10K  [0201]  109.47,23.83 0 top
R13839  10K  [0201]  109.47,24.43 0 top
R13840  10K  [0201]  109.47,25.04 0 top
R13841  10K  [0201]  109.47,25.65 0 top
R13842  10K  [0201]  109.47,26.26 0 top
R13843  10K  [0201]  109.47,26.87 0 top
R13844  10K  [0201]  109.47,27.48 0 top
R13845  10K  [0201]  109.47,28.09 0 top
R13846  10K  [0201]  109.47,28.7 0 top
R13847  10K  [0201]  109.47,29.31 0 top
R13848  10K  [0201]  109.47,29.92 0 top
R13849  10K  [0201]  109.47,30.53 0 top
R13850  10K  [0201]  109.47,31.14 0 top
R13851  10K  [0201]  109.47,31.75 0 top
R13852  10K  [0201]  109.47,32.36 0 top
R13853  10K  [0201]  109.47,32.97 0 top
R13854  10K  [0201]  109.47,33.58 0 top
R13855  10K  [0201]  109.47,34.19 0 top
R13856  10K  [0201]  109.47,34.8 0 top
R13857  10K  [0201]  109.47,35.41 0 top
R13858  10K  [0201]  109.47,36.02 0 top
R13859  10K  [0201]  109.47,36.63 0 top
R13860  10K  [0201]  109.47,37.24 0 top
R13861  10K  [0201]  109.47,37.85 0 top
R13862  10K  [0201]  109.47,38.46 0 top
R13863  10K  [0201]  109.47,39.07 0 top
R13864  10K  [0201]  109.47,39.67 0 top
R13865  10K  [0201]  109.47,40.28 0 top
R13866  10K  [0201]  109.47,40.89 0 top
R13867  10K  [0201]  109.47,41.5 0 top
R13868  10K  [0201]  109.47,42.11 0 top
R13869  10K  [0201]  109.47,42.72 0 top
R13870  10K  [0201]  109.47,43.33 0 top
R13871  10K  [0201]  109.47,43.94 0 top
R13872  10K  [0201]  109.47,44.55 0 top
R13873  10K  [0201]  109.47,45.16 0 top
R13874  10K  [0201]  109.47,45.77 0 top
R13875  10K  [0201]  109.47,46.38 0 top
R13876  10K  [0201]  109.47,46.99 0 top
R13877  10K  [0201]  109.47,47.6 0 top
R13878  10K  [0201]  109.47,48.21 0 top
R13879  10K  [0201]  109.47,48.82 0 top
R13880  10K  [0201]  109.47,49.43 0 top
R13881  10K  [0201]  109.47,50.04 0 top
R13882  10K  [0201]  109.47,50.65 0 top
R13883  10K  [0201]  109.47,51.26 0 top
R13884  10K  [0201]  109.47,51.87 0 top
R13885  10K  [0201]  109.47,52.48 0 top
R13886  10K  [0201]  109.47,53.09 0 top
R13887  10K  [0201]  109.47,53.7 0 top
R13888  10K  [0201]  109.47,54.31 0 top
R13889  10K  [0201]  109.47,54.91 0 top
R13890  10K  [0201]  109.47,55.52 0 top
R13891  10K  [0201]  109.47,56.13 0 top
R13892  10K  [0201]  109.47,56.74 0 top
R13893  10K  [0201]  109.47,57.35 0 top
R13894  10K  [0201]  109.47,57.96 0 top
R13895  10K  [0201]  109.47,58.57 0 top
R13896  10K  [0201]  109.47,59.18 0 top
R13897  10K  [0201]  109.47,59.79 0 top
R13898  10K  [0201]  109.47,60.4 0 top
R13899  10K  [0201]  109.47,61.01 0 top
R13900  10K  [0201]  109.47,61.62 0 top
R13901  10K  [0201]  109.47,62.23 0 top
R13902  10K  [0201]  109.47,62.84 0 top
R13903  10K  [0201]  109.47,63.45 0 top
R13904  10K  [0201]  109.47,64.06 0 top
R13905  10K  [0201]  109.47,64.67 0 top
R13906  10K  [0201]  109.47,65.28 0 top
R13907  10K  [0201]  109.47,65.89 0 top
R13908  10K  [0201]  109.47,66.5 0 top
R13909  10K  [0201]  109.47,67.11 0 top
R13910  10K  [0201]  109.47,67.72 0 top
R13911  10K  [0201]  109.47,68.33 0 top
R13912  10K  [0201]  109.47,68.94 0 top
R13913  10K  [0201]  109.47,69.55 0 top
R13914  10K  [0201]  109.47,70.15 0 top
R13915  10K  [0201]  109.47,70.76 0 top
R13916  10K  [0201]  109.47,71.37 0 top
R13917  10K  [0201]  109.47,71.98 0 top
R13918  10K  [0201]  109.47,72.59 0 top
R13919  10K  [0201]  109.47,73.2 0 top
R13920  10K  [0201]  109.47,73.81 0 top
R13921  10K  [0201]  109.47,74.42 0 top
R13922  10K  [0201]  109.47,75.03 0 top
R13923  10K  [0201]  109.47,75.64 0 top
R13924  10K  [0201]  109.47,76.25 0 top
R13925  10K  [0201]  109.47,76.86 0 top
R13926  10K  [0201]  109.47,77.47 0 top
R13927  10K  [0201]  109.47,78.08 0 top
R13928  10K  [0201]  109.47,78.69 0 top
R13929  10K  [0201]  109.47,79.3 0 top
R13930  10K  [0201]  109.47,79.91 0 top
R13931  10K  [0201]  109.47,80.52 0 top
R13932  10K  [0201]  109.47,81.13 0 top
R13933  10K  [0201]  109.47,81.74 0 top
R13934  10K  [0201]  109.47,82.35 0 top
R13935  10K  [0201]  109.47,82.96 0 top
R13936  10K  [0201]  109.47,83.57 0 top
R13937  10K  [0201]  109.47,84.18 0 top
R13938  10K  [0201]  109.47,84.79 0 top
R13939  10K  [0201]  109.47,85.39 0 top
R13940  10K  [0201]  109.47,86 0 top
R13941  10K  [0201]  109.47,86.61 0 top
R13942  10K  [0201]  109.47,87.22 0 top
R13943  10K  [0201]  109.47,87.83 0 top
R13944  10K  [0201]  109.47,88.44 0 top
R13945  10K  [0201]  109.47,89.05 0 top
R13946  10K  [0201]  109.47,89.66 0 top
R13947  10K  [0201]  109.47,90.27 0 top
R13948  10K  [0201]  109.47,90.88 0 top
R13949  10K  [0201]  109.47,91.49 0 top
R13950  10K  [0201]  109.47,92.1 0 top
R13951  10K  [0201]  109.47,92.71 0 top
R13952  10K  [0201]  109.47,93.32 0 top
R13953  10K  [0201]  109.47,93.93 0 top
R13954  10K  [0201]  109.47,94.54 0 top
R13955  10K  [0201]  109.47,95.15 0 top
R13956  10K  [0201]  109.47,95.76 0 top
R13957  10K  [0201]  109.47,96.37 0 top
R13958  10K  [0201]  109.47,96.98 0 top
R13959  10K  [0201]  109.47,97.59 0 top
R13960  10K  [0201]  109.47,98.2 0 top
R13961  10K  [0201]  109.47,98.81 0 top
R13962  10K  [0201]  109.47,99.42 0 top
R13963  10K  [0201]  109.47,100.03 0 top
R13964  10K  [0201]  109.47,100.63 0 top
R13965  10K  [0201]  109.47,101.24 0 top
R13966  10K  [0201]  109.47,101.85 0 top
R13967  10K  [0201]  109.47,102.46 0 top
R13968  10K  [0201]  109.47,103.07 0 top
R13969  10K  [0201]  109.47,103.68 0 top
R13970  10K  [0201]  109.47,104.29 0 top
R13971  10K  [0201]  109.47,104.9 0 top
R13972  10K  [0201]  109.47,105.51 0 top
R13973  10K  [0201]  109.47,106.12 0 top
R13974  10K  [0201]  109.47,106.73 0 top
R13975  10K  [0201]  109.47,107.34 0 top
R13976  10K  [0201]  109.47,107.95 0 top
R13977  10K  [0201]  109.47,108.56 0 top
R13978  10K  [0201]  109.47,109.17 0 top
R13979  10K  [0201]  109.47,109.78 0 top
R13980  10K  [0201]  109.47,110.39 0 top
R13981  10K  [0201]  109.47,111 0 top
R13982  10K  [0201]  109.47,111.61 0 top
R13983  10K  [0201]  109.47,112.22 0 top
R13984  10K  [0201]  109.47,112.83 0 top
R13985  10K  [0201]  109.47,113.44 0 top
R13986  10K  [0201]  109.47,114.05 0 top
R13987  10K  [0201]  109.47,114.66 0 top
R13988  10K  [0201]  109.47,115.27 0 top
R13989  10K  [0201]  109.47,115.87 0 top
R13990  10K  [0201]  109.47,116.48 0 top
R13991  10K  [0201]  109.47,117.09 0 top
R13992  10K  [0201]  109.47,117.7 0 top
R13993  10K  [0201]  109.47,118.31 0 top
R13994  10K  [0201]  109.47,118.92 0 top
R13995  10K  [0201]  109.47,119.53 0 top
R13996  10K  [0201]  109.47,120.14 0 top
R13997  10K  [0201]  109.47,120.75 0 top
R13998  10K  [0201]  109.47,121.36 0 top
R13999  10K  [0201]  109.47,121.97 0 top
R14000  10K  [0201]  109.47,122.58 0 top
R14001  10K  [0201]  110.69,1.27 0 top
R14002  10K  [0201]  110.69,1.88 0 top
R14003  10K  [0201]  110.69,2.49 0 top
R14004  10K  [0201]  110.69,3.1 0 top
R14005  10K  [0201]  110.69,3.71 0 top
R14006  10K  [0201]  110.69,4.32 0 top
R14007  10K  [0201]  110.69,4.93 0 top
R14008  10K  [0201]  110.69,5.54 0 top
R14009  10K  [0201]  110.69,6.15 0 top
R14010  10K  [0201]  110.69,6.76 0 top
R14011  10K  [0201]  110.69,7.37 0 top
R14012  10K  [0201]  110.69,7.98 0 top
R14013  10K  [0201]  110.69,8.59 0 top
R14014  10K  [0201]  110.69,9.19 0 top
R14015  10K  [0201]  110.69,9.8 0 top
R14016  10K  [0201]  110.69,10.41 0 top
R14017  10K  [0201]  110.69,11.02 0 top
R14018  10K  [0201]  110.69,11.63 0 top
R14019  10K  [0201]  110.69,12.24 0 top
R14020  10K  [0201]  110.69,12.85 0 top
R14021  10K  [0201]  110.69,13.46 0 top
R14022  10K  [0201]  110.69,14.07 0 top
R14023  10K  [0201]  110.69,14.68 0 top
R14024  10K  [0201]  110.69,15.29 0 top
R14025  10K  [0201]  110.69,15.9 0 top
R14026  10K  [0201]  110.69,16.51 0 top
R14027  10K  [0201]  110.69,17.12 0 top
R14028  10K  [0201]  110.69,17.73 0 top
R14029  10K  [0201]  110.69,18.34 0 top
R14030  10K  [0201]  110.69,18.95 0 top
R14031  10K  [0201]  110.69,19.56 0 top
R14032  10K  [0201]  110.69,20.17 0 top
R14033  10K  [0201]  110.69,20.78 0 top
R14034  10K  [0201]  110.69,21.39 0 top
R14035  10K  [0201]  110.69,22 0 top
R14036  10K  [0201]  110.69,22.61 0 top
R14037  10K  [0201]  110.69,23.22 0 top
R14038  10K  [0201]  110.69,23.83 0 top
R14039  10K  [0201]  110.69,24.43 0 top
R14040  10K  [0201]  110.69,25.04 0 top
R14041  10K  [0201]  110.69,25.65 0 top
R14042  10K  [0201]  110.69,26.26 0 top
R14043  10K  [0201]  110.69,26.87 0 top
R14044  10K  [0201]  110.69,27.48 0 top
R14045  10K  [0201]  110.69,28.09 0 top
R14046  10K  [0201]  110.69,28.7 0 top
R14047  10K  [0201]  110.69,29.31 0 top
R14048  10K  [0201]  110.69,29.92 0 top
R14049  10K  [0201]  110.69,30.53 0 top
R14050  10K  [0201]  110.69,31.14 0 top
R14051  10K  [0201]  110.69,31.75 0 top
R14052  10K  [0201]  110.69,32.36 0 top
R14053  10K  [0201]  110.69,32.97 0 top
R14054  10K  [0201]  110.69,33.58 0 top
R14055  10K  [0201]  110.69,34.19 0 top
R14056  10K  [0201]  110.69,34.8 0 top
R14057  10K  [0201]  110.69,35.41 0 top
R14058  10K  [0201]  110.69,36.02 0 top
R14059  10K  [0201]  110.69,36.63 0 top
R14060  10K  [0201]  110.69,37.24 0 top
R14061  10K  [0201]  110.69,37.85 0 top
R14062  10K  [0201]  110.69,38.46 0 top
R14063  10K  [0201]  110.69,39.07 0 top
R14064  10K  [0201]  110.69,39.67 0 top
R14065  10K  [0201]  110.69,40.28 0 top
R14066  10K  [0201]  110.69,40.89 0 top
R14067  10K  [0201]  110.69,41.5 0 top
R14068  10K  [0201]  110.69,42.11 0 top
R14069  10K  [0201]  110.69,42.72 0 top
R14070  10K  [0201]  110.69,43.33 0 top
R14071  10K  [0201]  110.69,43.94 0 top
R14072  10K  [0201]  110.69,44.55 0 top
R14073  10K  [0201]  110.69,45.16 0 top
R14074  10K  [0201]  110.69,45.77 0 top
R14075  10K  [0201]  110.69,46.38 0 top
R14076  10K  [0201]  110.69,46.99 0 top
R14077  10K  [0201]  110.69,47.6 0 top
R14078  10K  [0201]  110.69,48.21 0 top
R14079  10K  [0201]  110.69,48.82 0 top
R14080  10K  [0201]  110.69,49.43 0 top
R14081  10K  [0201]  110.69,50.04 0 top
R14082  10K  [0201]  110.69,50.65 0 top
R14083  10K  [0201]  110.69,51.26 0 top
R14084  10K  [0201]  110.69,51.87 0 top
R14085  10K  [0201]  110.69,52.48 0 top
R14086  10K  [0201]  110.69,53.09 0 top
R14087  10K  [0201]  110.69,53.7 0 top
R14088  10K  [0201]  110.69,54.31 0 top
R14089  10K  [0201]  110.69,54.91 0 top
R14090  10K  [0201]  110.69,55.52 0 top
R14091  10K  [0201]  110.69,56.13 0 top
R14092  10K  [0201]  110.69,56.74 0 top
R14093  10K  [0201]  110.69,57.35 0 top
R14094  10K  [0201]  110.69,57.96 0 top
R14095  10K  [0201]  110.69,58.57 0 top
R14096  10K  [0201]  110.69,59.18 0 top
R14097  10K  [0201]  110.69,59.79 0 top
R14098  10K  [0201]  110.69,60.4 0 top
R14099  10K  [0201]  110.69,61.01 0 top
R14100  10K  [0201]  110.69,61.62 0 top
R14101  10K  [0201]  110.69,62.23 0 top
R14102  10K  [0201]  110.69,62.84 0 top
R14103  10K  [0201]  110.69,63.45 0 top
R14104  10K  [0201]  110.69,64.06 0 top
R14105  10K  [0201]  110.69,64.67 0 top
R14106  10K  [0201]  110.69,65.28 0 top
R14107  10K  [0201]  110.69,65.89 0 top
R14108  10K  [0201]  110.69,66.5 0 top
R14109  10K  [0201]  110.69,67.11 0 top
R14110  10K  [0201]  110.69,67.72 0 top
R14111  10K  [0201]  110.69,68.33 0 top
R14112  10K  [0201]  110.69,68.94 0 top
R14113  10K  [0201]  110.69,69.55 0 top
R14114  10K  [0201]  110.69,70.15 0 top
R14115  10K  [0201]  110.69,70.76 0 top
R14116  10K  [0201]  110.69,71.37 0 top
R14117  10K  [0201]  110.69,71.98 0 top
R14118  10K  [0201]  110.69,72.59 0 top
R14119  10K  [0201]  110.69,73.2 0 top
R14120  10K  [0201]  110.69,73.81 0 top
R14121  10K  [0201]  110.69,74.42 0 top
R14122  10K  [0201]  110.69,75.03 0 top
R14123  10K  [0201]  110.69,75.64 0 top
R14124  10K  [0201]  110.69,76.25 0 top
R14125  10K  [0201]  110.69,76.86 0 top
R14126  10K  [0201]  110.69,77.47 0 top
R14127  10K  [0201]  110.69,78.08 0 top
R14128  10K  [0201]  110.69,78.69 0 top
R14129  10K  [0201]  110.69,79.3 0 top
R14130  10K  [0201]  110.69,79.91 0 top
R14131  10K  [0201]  110.69,80.52 0 top
R14132  10K  [0201]  110.69,81.13 0 top
R14133  10K  [0201]  110.69,81.74 0 top
R14134  10K  [0201]  110.69,82.35 0 top
R14135  10K  [0201]  110.69,82.96 0 top
R14136  10K  [0201]  110.69,83.57 0 top
R14137  10K  [0201]  110.69,84.18 0 top
R14138  10K  [0201]  110.69,84.79 0 top
R14139  10K  [0201]  110.69,85.39 0 top
R14140  10K  [0201]  110.69,86 0 top
R14141  10K  [0201]  110.69,86.61 0 top
R14142  10K  [0201]  110.69,87.22 0 top
R14143  10K  [0201]  110.69,87.83 0 top
R14144  10K  [0201]  110.69,88.44 0 top
R14145  10K  [0201]  110.69,89.05 0 top
R14146  10K  [0201]  110.69,89.66 0 top
R14147  10K  [0201]  110.69,90.27 0 top
R14148  10K  [0201]  110.69,90.88 0 top
R14149  10K  [0201]  110.69,91.49 0 top
R14150  10K  [0201]  110.69,92.1 0 top
R14151  10K  [0201]  110.69,92.71 0 top
R14152  10K  [0201]  110.69,93.32 0 top
R14153  10K  [0201]  110.69,93.93 0 top
R14154  10K  [0201]  110.69,94.54 0 top
R14155  10K  [0201]  110.69,95.15 0 top
R14156  10K  [0201]  110.69,95.76 0 top
R14157  10K  [0201]  110.69,96.37 0 top
R14158  10K  [0201]  110.69,96.98 0 top
R14159  10K  [0201]  110.69,97.59 0 top
R14160  10K  [0201]  110.69,98.2 0 top
R14161  10K  [0201]  110.69,98.81 0 top
R14162  10K  [0201]  110.69,99.42 0 top
R14163  10K  [0201]  110.69,100.03 0 top
R14164  10K  [0201]  110.69,100.63 0 top
R14165  10K  [0201]  110.69,101.24 0 top
R14166  10K  [0201]  110.69,101.85 0 top
R14167  10K  [0201]  110.69,102.46 0 top
R14168  10K  [0201]  110.69,103.07 0 top
R14169  10K  [0201]  110.69,103.68 0 top
R14170  10K  [0201]  110.69,104.29 0 top
R14171  10K  [0201]  110.69,104.9 0 top
R14172  10K  [0201]  110.69,105.51 0 top
R14173  10K  [0201]  110.69,106.12 0 top
R14174  10K  [0201]  110.69,106.73 0 top
R14175  10K  [0201]  110.69,107.34 0 top
R14176  10K  [0201]  110.69,107.95 0 top
R14177  10K  [0201]  110.69,108.56 0 top
R14178  10K  [0201]  110.69,109.17 0 top
R14179  10K  [0201]  110.69,109.78 0 top
R14180  10K  [0201]  110.69,110.39 0 top
R14181  10K  [0201]  110.69,111 0 top
R14182  10K  [0201]  110.69,111.61 0 top
R14183  10K  [0201]  110.69,112.22 0 top
R14184  10K  [0201]  110.69,112.83 0 top
R14185  10K  [0201]  110.69,113.44 0 top
R14186  10K  [0201]  110.69,114.05 0 top
R14187  10K  [0201]  110.69,114.66 0 top
R14188  10K  [0201]  110.69,115.27 0 top
R14189  10K  [0201]  110.69,115.87 0 top
R14190  10K  [0201]  110.69,116.48 0 top
R14191  10K  [0201]  110.69,117.09 0 top
R14192  10K  [0201]  110.69,117.7 0 top
R14193  10K  [0201]  110.69,118.31 0 top
R14194  10K  [0201]  110.69,118.92 0 top
R14195  10K  [0201]  110.69,119.53 0 top
R14196  10K  [0201]  110.69,120.14 0 top
R14197  10K  [0201]  110.69,120.75 0 top
R14198  10K  [0201]  110.69,121.36 0 top
R14199  10K  [0201]  110.69,121.97 0 top
R14200  10K  [0201]  110.69,122.58 0 top
R14201  10K  [0201]  111.91,1.27 0 top
R14202  10K  [0201]  111.91,1.88 0 top
R14203  10K  [0201]  111.91,2.49 0 top
R14204  10K  [0201]  111.91,3.1 0 top
R14205  10K  [0201]  111.91,3.71 0 top
R14206  10K  [0201]  111.91,4.32 0 top
R14207  10K  [0201]  111.91,4.93 0 top
R14208  10K  [0201]  111.91,5.54 0 top
R14209  10K  [0201]  111.91,6.15 0 top
R14210  10K  [0201]  111.91,6.76 0 top
R14211  10K  [0201]  111.91,7.37 0 top
R14212  10K  [0201]  111.91,7.98 0 top
R14213  10K  [0201]  111.91,8.59 0 top
R14214  10K  [0201]  111.91,9.19 0 top
R14215  10K  [0201]  111.91,9.8 0 top
R14216  10K  [0201]  111.91,10.41 0 top
R14217  10K  [0201]  111.91,11.02 0 top
R14218  10K  [0201]  111.91,11.63 0 top
R14219  10K  [0201]  111.91,12.24 0 top
R14220  10K  [0201]  111.91,12.85 0 top
R14221  10K  [0201]  111.91,13.46 0 top
R14222  10K  [0201]  111.91,14.07 0 top
R14223  10K  [0201]  111.91,14.68 0 top
R14224  10K  [0201]  111.91,15.29 0 top
R14225  10K  [0201]  111.91,15.9 0 top
R14226  10K  [0201]  111.91,16.51 0 top
R14227  10K  [0201]  111.91,17.12 0 top
R14228  10K  [0201]  111.91,17.73 0 top
R14229  10K  [0201]  111.91,18.34 0 top
R14230  10K  [0201]  111.91,18.95 0 top
R14231  10K  [0201]  111.91,19.56 0 top
R14232  10K  [0201]  111.91,20.17 0 top
R14233  10K  [0201]  111.91,20.78 0 top
R14234  10K  [0201]  111.91,21.39 0 top
R14235  10K  [0201]  111.91,22 0 top
R14236  10K  [0201]  111.91,22.61 0 top
R14237  10K  [0201]  111.91,23.22 0 top
R14238  10K  [0201]  111.91,23.83 0 top
R14239  10K  [0201]  111.91,24.43 0 top
R14240  10K  [0201]  111.91,25.04 0 top
R14241  10K  [0201]  111.91,25.65 0 top
R14242  10K  [0201]  111.91,26.26 0 top
R14243  10K  [0201]  111.91,26.87 0 top
R14244  10K  [0201]  111.91,27.48 0 top
R14245  10K  [0201]  111.91,28.09 0 top
R14246  10K  [0201]  111.91,28.7 0 top
R14247  10K  [0201]  111.91,29.31 0 top
R14248  10K  [0201]  111.91,29.92 0 top
R14249  10K  [0201]  111.91,30.53 0 top
R14250  10K  [0201]  111.91,31.14 0 top
R14251  10K  [0201]  111.91,31.75 0 top
R14252  10K  [0201]  111.91,32.36 0 top
R14253  10K  [0201]  111.91,32.97 0 top
R14254  10K  [0201]  111.91,33.58 0 top
R14255  10K  [0201]  111.91,34.19 0 top
R14256  10K  [0201]  111.91,34.8 0 top